# EasyEDA Pro project remote-a-v101.eprj, board main-board
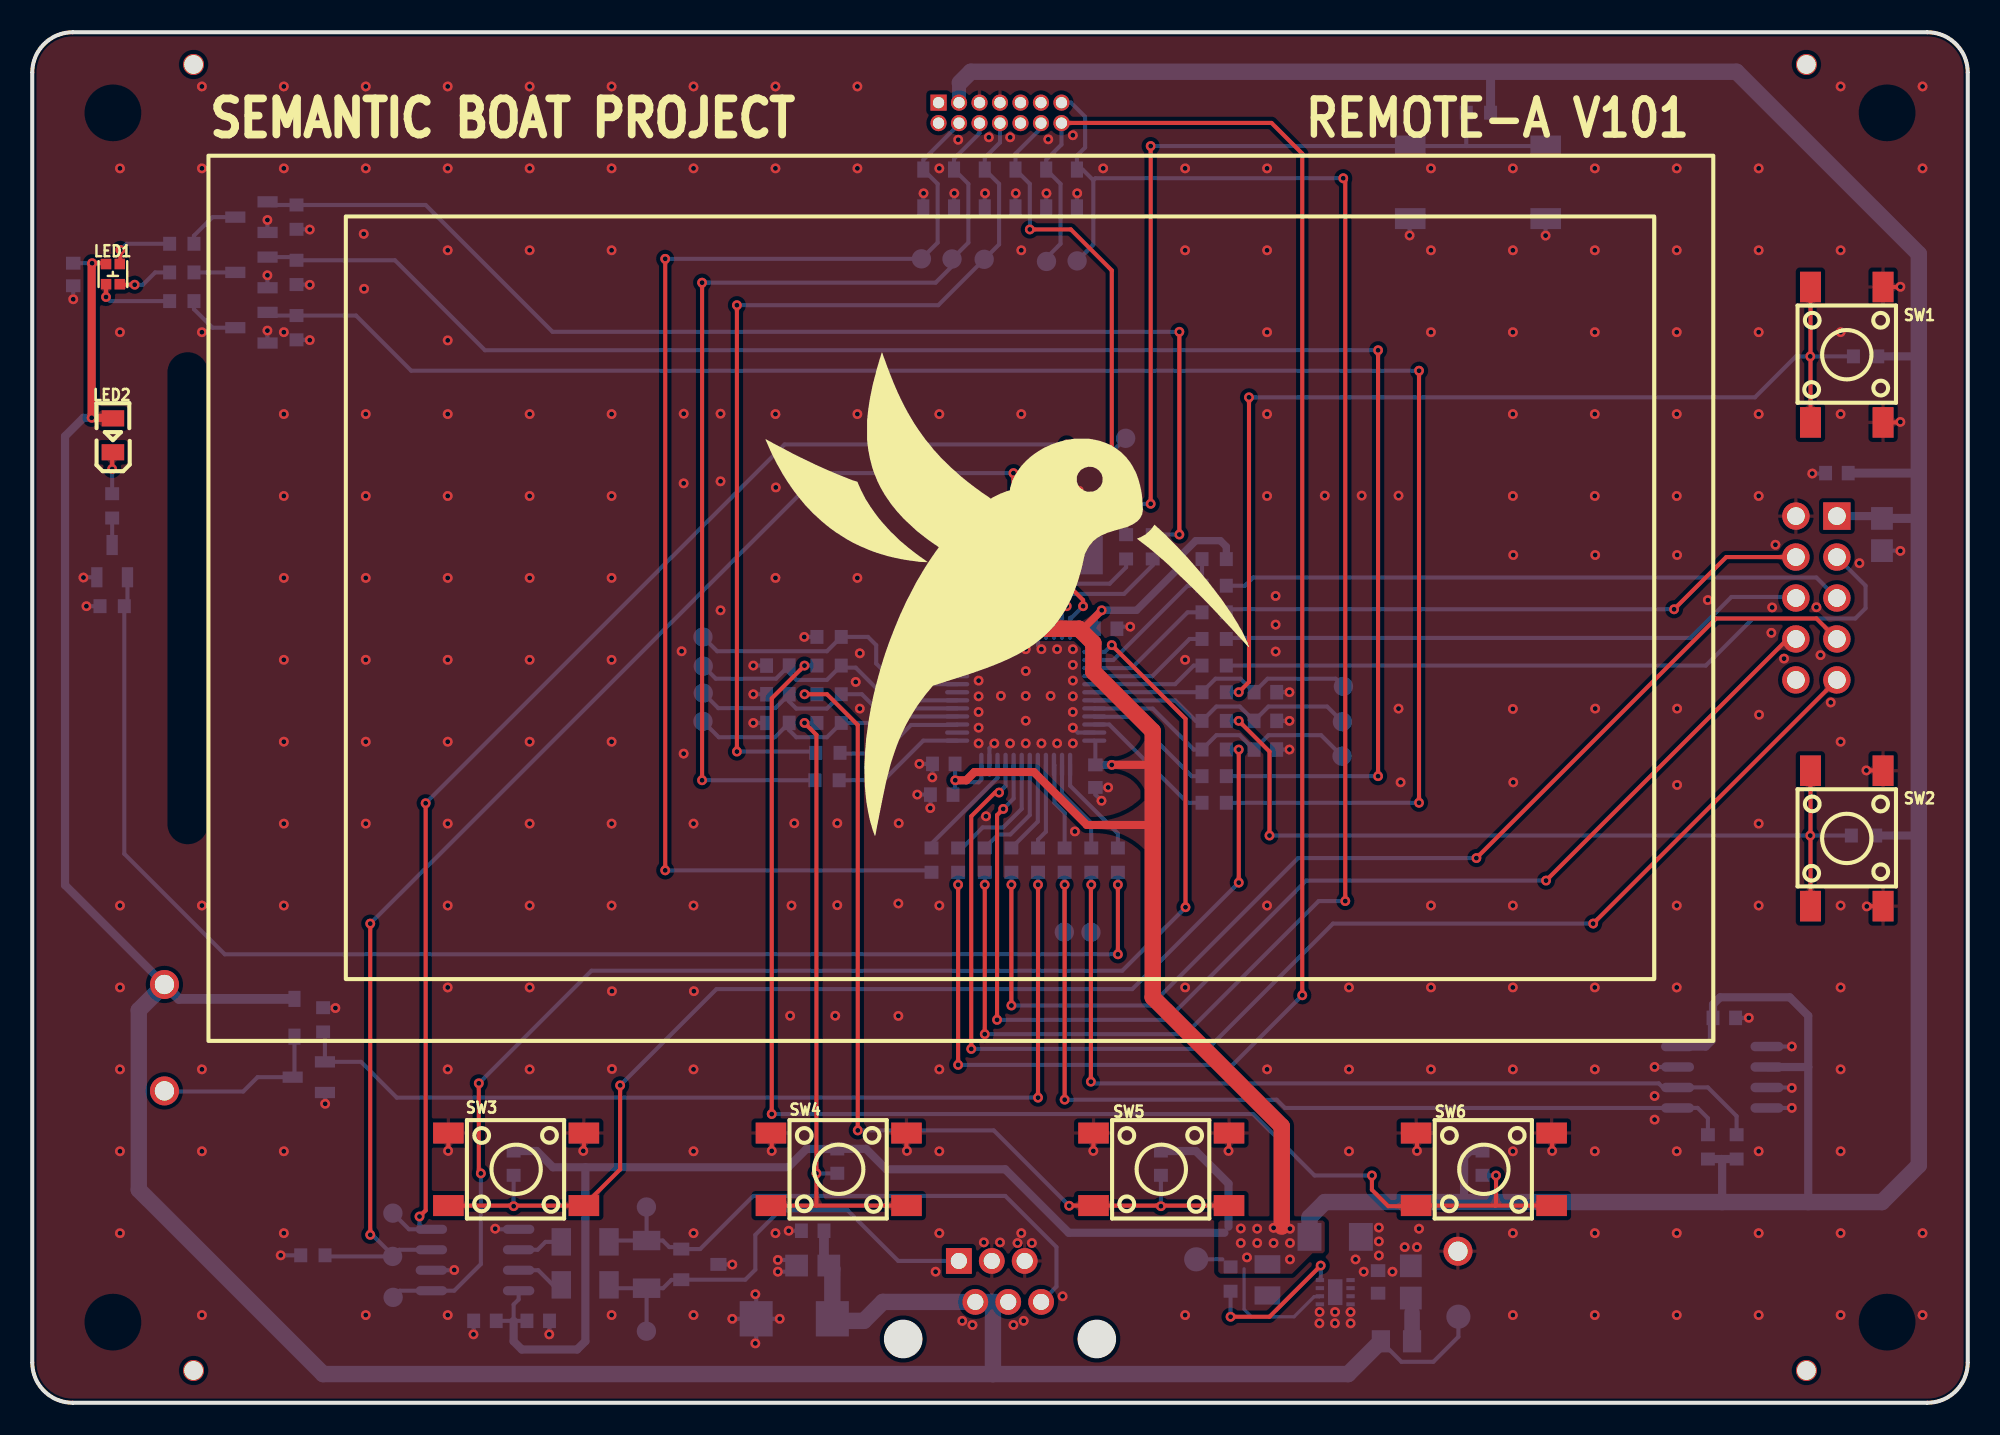
[diagram p1: board, top side]
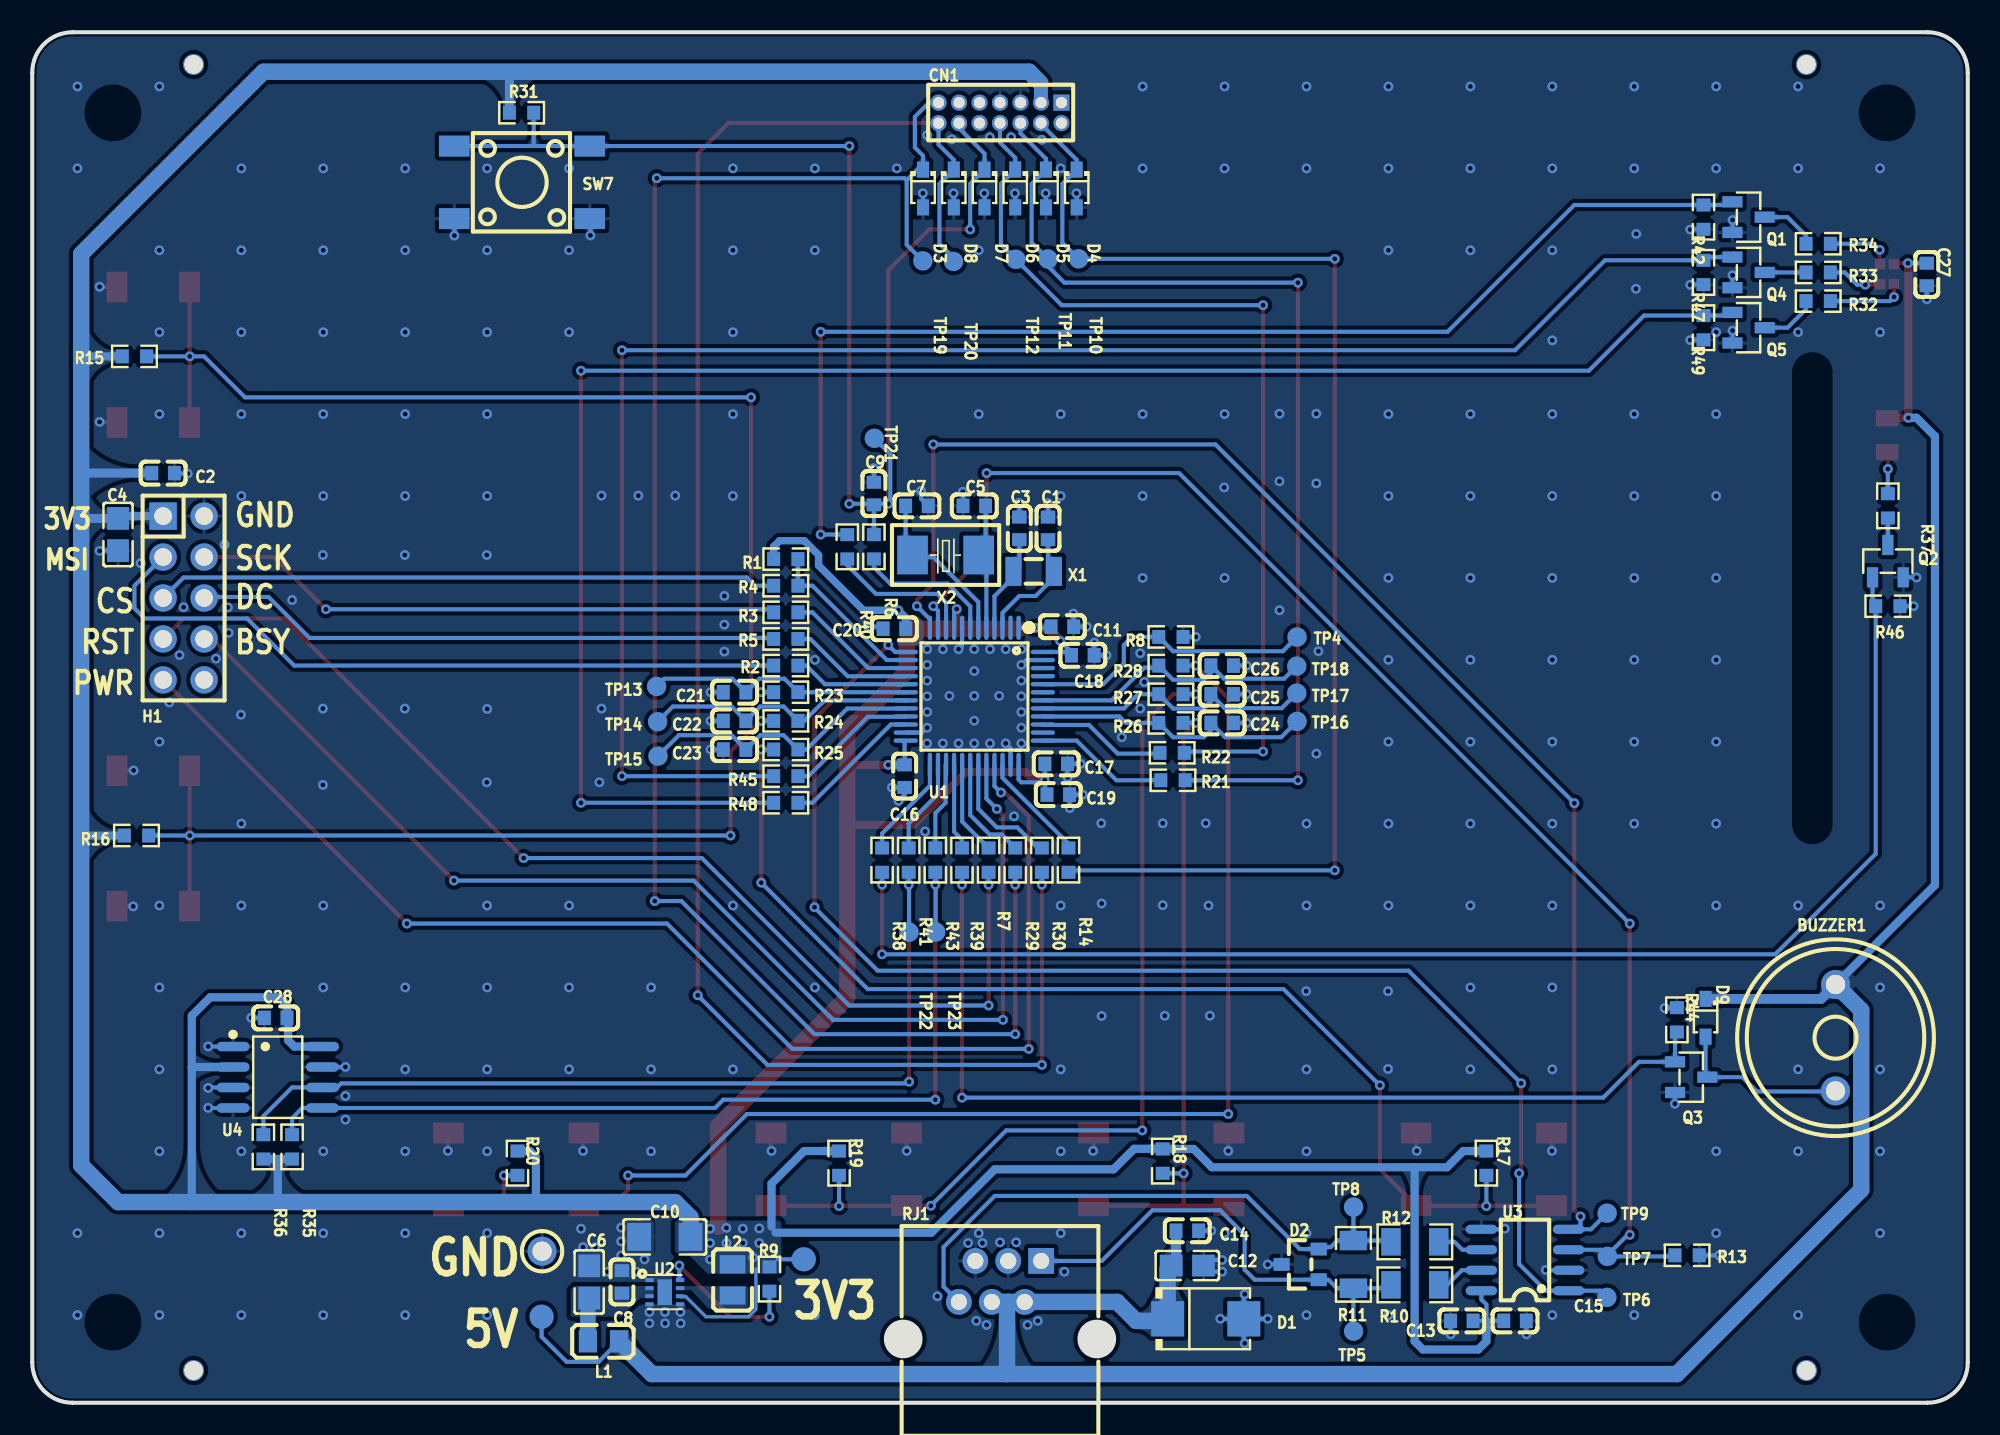
[diagram p2: board, bottom side, seen from below]

Outline 120 x 85 mm; copper layers: Top Layer, Inner1, Inner2, Bottom Layer. Coordinates in mm from the lower left corner of the outline.
Outline path: 0,82.5 0,2.5 arc(0.73,0.73) 2.5,0 117.5,0 arc(119.27,0.73) 120,2.5 120,82.5 arc(119.27,84.27) 117.5,85 2.5,85 arc(0.73,84.27) 0,82.5
Stack: Top Layer 0.035mm Outer layer thickness 1oz / Dielectric1 0.2104mm 7628 RC49% 8.6mil / Inner1 0.0152mm Inner layer thickness / Dielectric2 1.065mm 1.1mm H/HOZ Copper / Inner2 0.0152mm Inner layer thickness / Dielectric3 0.2104mm 7628 RC49% 8.6mil / Bottom Layer 0.035mm Outer layer thickness 1oz

## Design rules (mm)
template: JLCPCB Capability(Two Layers Board)
spacing copperThickness1oz (default): track to track 0.102, other pairs 0.152 to 0.3
spacing copperThickness2oz: track to track 0.203, other pairs 0.152 to 0.3
track width copperThickness1oz (default): min 0.127, default 0.254, max 2.54
track width copperThickness2oz: min 0.203, default 0.254, max 2.54
differential pair differentialPair (default): width min 0.127, default 0.254, max 2.54; gap min 0.152, default 0.152
via viaSize (default): diameter min 0.5, default 0.61, max 10; hole min 0.3, default 0.305, max 6.3

## Placement (name value [footprint] x y rotation side)
BUZZER1  2kHz  [BUZ-TH_BD12.0-P6.50-D0.8]  8.2 22.64 270 bottom
C1  22pF  [C0603]  57.02 54.23 270 bottom
C2  100nF  [C0603]  111.89 57.66 180 bottom
C3  22pF  [C0603]  58.8 54.23 270 bottom
C4  22uF  [C0805]  114.68 53.85 270 bottom
C5  33pF  [C0603]  61.59 55.63 180 bottom
C6  10uF  [C0805]  85.47 7.49 90 bottom
C7  33pF  [C0603]  65.15 55.63 0 bottom
C8  100nF  [C0603]  83.44 7.49 90 bottom
C9  100nF  [C0603]  67.82 56.39 270 bottom
C10  22uF  [C1206]  80.78 10.29 0 bottom
C11  100nF  [C0603]  56.13 48.13 180 bottom
C12  22uF  [C0805]  48.39 8.51 0 bottom
C13  1uF  [C0603]  31.37 5.08 180 bottom
C14  100nF  [C0603]  48.39 10.67 180 bottom
C15  100nF  [C0603]  28.07 5.08 0 bottom
C16  100nF  [C0603]  65.91 38.86 90 bottom
C17  100nF  [C0603]  56.51 39.62 180 bottom
C18  100nF  [C0603]  54.86 46.36 180 bottom
C19  4.7uF  [C0603]  56.39 37.72 180 bottom
C20  100nF  [C0603]  66.55 48.01 0 bottom
C21  100nF  [C0603]  76.45 44.07 180 bottom
C22  100nF  [C0603]  76.45 42.29 180 bottom
C23  100nF  [C0603]  76.45 40.51 180 bottom
C24  100nF  [C0603]  46.23 42.16 0 bottom
C25  100nF  [C0603]  46.23 43.94 0 bottom
C26  100nF  [C0603]  46.23 45.72 0 bottom
C27  100nF  [C0603]  2.54 69.98 270 bottom
C28  100nF  [C0603]  104.91 23.87 180 bottom
CN1  ZX-PZ1.27-2-7PZZ  [HDR-TH_14P-P1.27-V-M-R2-C7-S1.27-2]  60 80 0 bottom
D1  SMBJ5.0A  [SMB_L4.6-W3.6-LS5.3-RD]  47.24 5.21 180 bottom
D2  SM712-02HTG  [SOT-23_L2.9-W1.3-P1.90-LS2.4-BR]  41.39 8.58 180 bottom
D3  PESD5V0U1UA,115  [SOD-323_L1.8-W1.3-LS2.5-RD]  64.77 75.31 270 bottom
D4  PESD5V0U1UA,115  [SOD-323_L1.8-W1.3-LS2.5-RD]  55.25 75.31 270 bottom
D5  PESD5V0U1UA,115  [SOD-323_L1.8-W1.3-LS2.5-RD]  57.15 75.31 270 bottom
D6  PESD5V0U1UA,115  [SOD-323_L1.8-W1.3-LS2.5-RD]  59.06 75.31 270 bottom
D7  PESD5V0U1UA,115  [SOD-323_L1.8-W1.3-LS2.5-RD]  60.96 75.31 270 bottom
D8  PESD5V0U1UA,115  [SOD-323_L1.8-W1.3-LS2.5-RD]  62.87 75.31 270 bottom
D9  1N4148WS  [SOD-323_L1.8-W1.3-LS2.5-RD]  16.26 23.88 270 bottom
H1  PZ254V-12-10P  [HDR-TH_10P-P2.54-V-M-R2-C5-S2.54]  110.62 49.91 270 bottom
L1  BLM21PG331SN1D  [L0805]  84.58 3.81 180 bottom
L2  2.2uH  [IND-SMD_L2.0-W1.6-1]  76.58 7.62 90 bottom
LED1  SZYY1615RGB-B 4pin  [LED-SMD_4P-L1.6-W1.5-TR-1]  5 70 0 top
LED2  KT-0805G  [LED0805-R-RD]  5 60 90 top
NOREF  -  [Pad_e112]  110 83 0 top
NOREF#2  -  [Pad_e96]  10 2 0 top
NOREF#3  -  [Pad_e110]  10 83 0 top
NOREF#4  -  [Pad_e111]  110 2 0 top
Q1  2N7002  [SOT-23-3_L2.9-W1.3-P1.90-LS2.4-BR]  13.59 73.53 0 bottom
Q2  2N7002  [SOT-23-3_L2.9-W1.3-P1.90-LS2.4-BR]  4.95 52.2 270 bottom
Q3  2N7002  [SOT-23-3_L2.9-W1.3-P1.90-LS2.4-BR]  17.14 20.19 0 bottom
Q4  2N7002  [SOT-23-3_L2.9-W1.3-P1.90-LS2.4-BR]  13.59 70.1 0 bottom
Q5  2N7002  [SOT-23-3_L2.9-W1.3-P1.90-LS2.4-BR]  13.59 66.67 0 bottom
R1  10kΩ  [R0603]  73.28 52.32 0 bottom
R2  47Ω  [R0603]  73.28 45.72 180 bottom
R3  47Ω  [R0603]  73.28 49.02 0 bottom
R4  47Ω  [R0603]  73.28 50.67 180 bottom
R5  47Ω  [R0603]  73.28 47.37 0 bottom
R6  220Ω  [R0603]  67.82 53.09 270 bottom
R7  47Ω  [R0603]  60.71 33.66 90 bottom
R8  47kΩ  [R0603]  49.4 47.5 0 bottom
R9  100kΩ  [R0603]  74.29 7.67 90 bottom
R10  10Ω  [R1206]  34.28 7.31 0 bottom
R11  120Ω  [R1206]  38.09 8.58 270 bottom
R12  10Ω  [R1206]  34.28 9.98 0 bottom
R13  100kΩ  [R0603]  17.4 9.14 0 bottom
R14  47Ω  [R0603]  55.75 33.66 270 bottom
R15  10kΩ  [R0603]  113.66 64.9 0 bottom
R16  10kΩ  [R0603]  113.54 35.18 0 bottom
R17  10kΩ  [R0603]  29.84 14.86 90 bottom
R18  10kΩ  [R0603]  49.91 14.99 90 bottom
R19  10kΩ  [R0603]  69.98 14.86 90 bottom
R20  10kΩ  [R0603]  89.92 14.86 90 bottom
R21  47Ω  [R0603]  49.28 38.61 180 bottom
R22  100Ω  [R0603]  49.33 40.31 180 bottom
R23  1kΩ  [R0603]  73.28 44.07 180 bottom
R24  1kΩ  [R0603]  73.28 42.29 180 bottom
R25  1kΩ  [R0603]  73.28 40.51 180 bottom
R26  1kΩ  [R0603]  49.4 42.16 0 bottom
R27  1kΩ  [R0603]  49.4 43.94 0 bottom
R28  1kΩ  [R0603]  49.4 45.72 0 bottom
R29  100Ω  [R0603]  59.06 33.66 270 bottom
R30  100Ω  [R0603]  57.4 33.66 270 bottom
R31  10kΩ  [R0603]  89.66 80.01 0 bottom
R32  100Ω  [R0603]  9.27 68.33 180 bottom
R33  100Ω  [R0603]  9.27 70.1 180 bottom
R34  150Ω  [R0603]  9.27 71.88 180 bottom
R35  2.2kΩ  [R0603]  103.89 15.87 270 bottom
R36  2.2kΩ  [R0603]  105.67 15.87 270 bottom
R37  1.8kΩ  [R0603]  4.95 55.63 90 bottom
R38  100Ω  [R0603]  67.31 33.66 90 bottom
R39  100Ω  [R0603]  62.36 33.66 90 bottom
R40  100Ω  [R0603]  69.47 53.09 270 bottom
R41  47Ω  [R0603]  65.66 33.66 270 bottom
R42  100kΩ  [R0603]  16.38 73.53 270 bottom
R43  47Ω  [R0603]  64.01 33.66 270 bottom
R44  100kΩ  [R0603]  18.03 23.75 90 bottom
R45  100Ω  [R0603]  73.28 38.86 0 bottom
R46  100kΩ  [R0603]  4.95 49.4 180 bottom
R47  100kΩ  [R0603]  16.38 70.1 270 bottom
R48  100Ω  [R0603]  73.28 37.21 0 bottom
R49  100kΩ  [R0603]  16.38 66.67 270 bottom
RJ1  R-RJ11R06P-A800  [RJ11-TH_PCB-6P6C-90]  60 7.53 180 bottom
SW1  TS-1002S-05026C  [KEY-SMD_4P-L6.0-W6.0-P4.50-LS9.0]  112.5 65 270 top
SW2  TS-1002S-05026C  [KEY-SMD_4P-L6.0-W6.0-P4.50-LS9.0]  112.5 35 270 top
SW3  TS-1002S-05026C  [KEY-SMD_4P-L6.0-W6.0-P4.50-LS9.0]  30 14.48 0 top
SW4  TS-1002S-05026C  [KEY-SMD_4P-L6.0-W6.0-P4.50-LS9.0]  50 14.48 0 top
SW5  TS-1002S-05026C  [KEY-SMD_4P-L6.0-W6.0-P4.50-LS9.0]  70 14.48 0 top
SW6  TS-1002S-05026C  [KEY-SMD_4P-L6.0-W6.0-P4.50-LS9.0]  90 14.48 0 top
SW7  TS-1002S-05026C  [KEY-SMD_4P-L6.0-W6.0-P4.50-LS9.0]  89.63 75.69 180 bottom
TP1  RH-5004  [TESTPOINT_TH_BD2.5-D1.2]  88.39 9.4 180 bottom
TP2  -  [Test-Point-0.5mm#2]  88.42 5.34 180 bottom
TP3  -  [Test-Point-0.5mm#2]  72.16 8.9 180 bottom
TP4  -  [Test-Point-0.5mm]  41.58 47.49 180 bottom
TP5  -  [Test-Point-0.5mm]  38.08 4.44 180 bottom
TP6  -  [Test-Point-0.5mm]  22.37 6.54 180 bottom
TP7  -  [Test-Point-0.5mm]  22.34 9.08 180 bottom
TP8  -  [Test-Point-0.5mm]  38.08 12.14 180 bottom
TP9  -  [Test-Point-0.5mm]  22.36 11.76 180 bottom
TP10  -  [Test-Point-0.5mm]  55.13 70.95 0 bottom
TP11  -  [Test-Point-0.5mm]  57.03 70.94 0 bottom
TP12  -  [Test-Point-0.5mm]  59.02 70.92 0 bottom
TP13  -  [Test-Point-0.5mm]  81.29 44.43 90 bottom
TP14  -  [Test-Point-0.5mm]  81.23 42.23 90 bottom
TP15  -  [Test-Point-0.5mm]  81.21 40.1 270 bottom
TP16  -  [Test-Point-0.5mm]  41.58 42.26 270 bottom
TP17  -  [Test-Point-0.5mm]  41.6 44.01 90 bottom
TP18  -  [Test-Point-0.5mm]  41.6 45.69 90 bottom
TP19  -  [Test-Point-0.5mm]  64.78 70.82 0 bottom
TP20  -  [Test-Point-0.5mm]  62.88 70.78 0 bottom
TP21  -  [Test-Point-0.5mm]  67.79 59.82 180 bottom
TP22  -  [Test-Point-0.5mm]  65.64 29.18 180 bottom
TP23  -  [Test-Point-0.5mm]  63.99 29.19 180 bottom
U1  STM32L431CCT6  [LQFP-48_L7.0-W7.0-P0.50-LS9.0-BL]  61.59 43.81 0 bottom
U2  TPS62162DSGR  [WSON-8_L2.0-W2.0-P0.50-TL-EP]  80.78 6.86 180 bottom
U3  SN65HVD72DR  [SOIC-8_L5.0-W4.0-P1.27-LS6.0-BL]  27.45 8.85 90 bottom
U4  AT24C256C-SSHL-T  [SOIC-8_L4.9-W3.9-P1.27-LS6.0-BL]  104.78 20.19 270 bottom
X1  32.768kHz  [FC-135R_L3.2-W1.5]  57.91 51.56 180 bottom
X2  8MHz  [CRYSTAL-SMD_L5.0-W3.2]  63.37 52.58 180 bottom
